# EasyEDA Pro project 天猛星1.eprj

# Schematic Schematic1
Board Name: Board1; Create Date: 2025-07-03; Page Name: P1; Project Name: 天猛星; Schematic Name: Schematic1; Update Date: 2025-07-04; Company: 嘉立创EDA; Page Size: A4; Version: V1.0
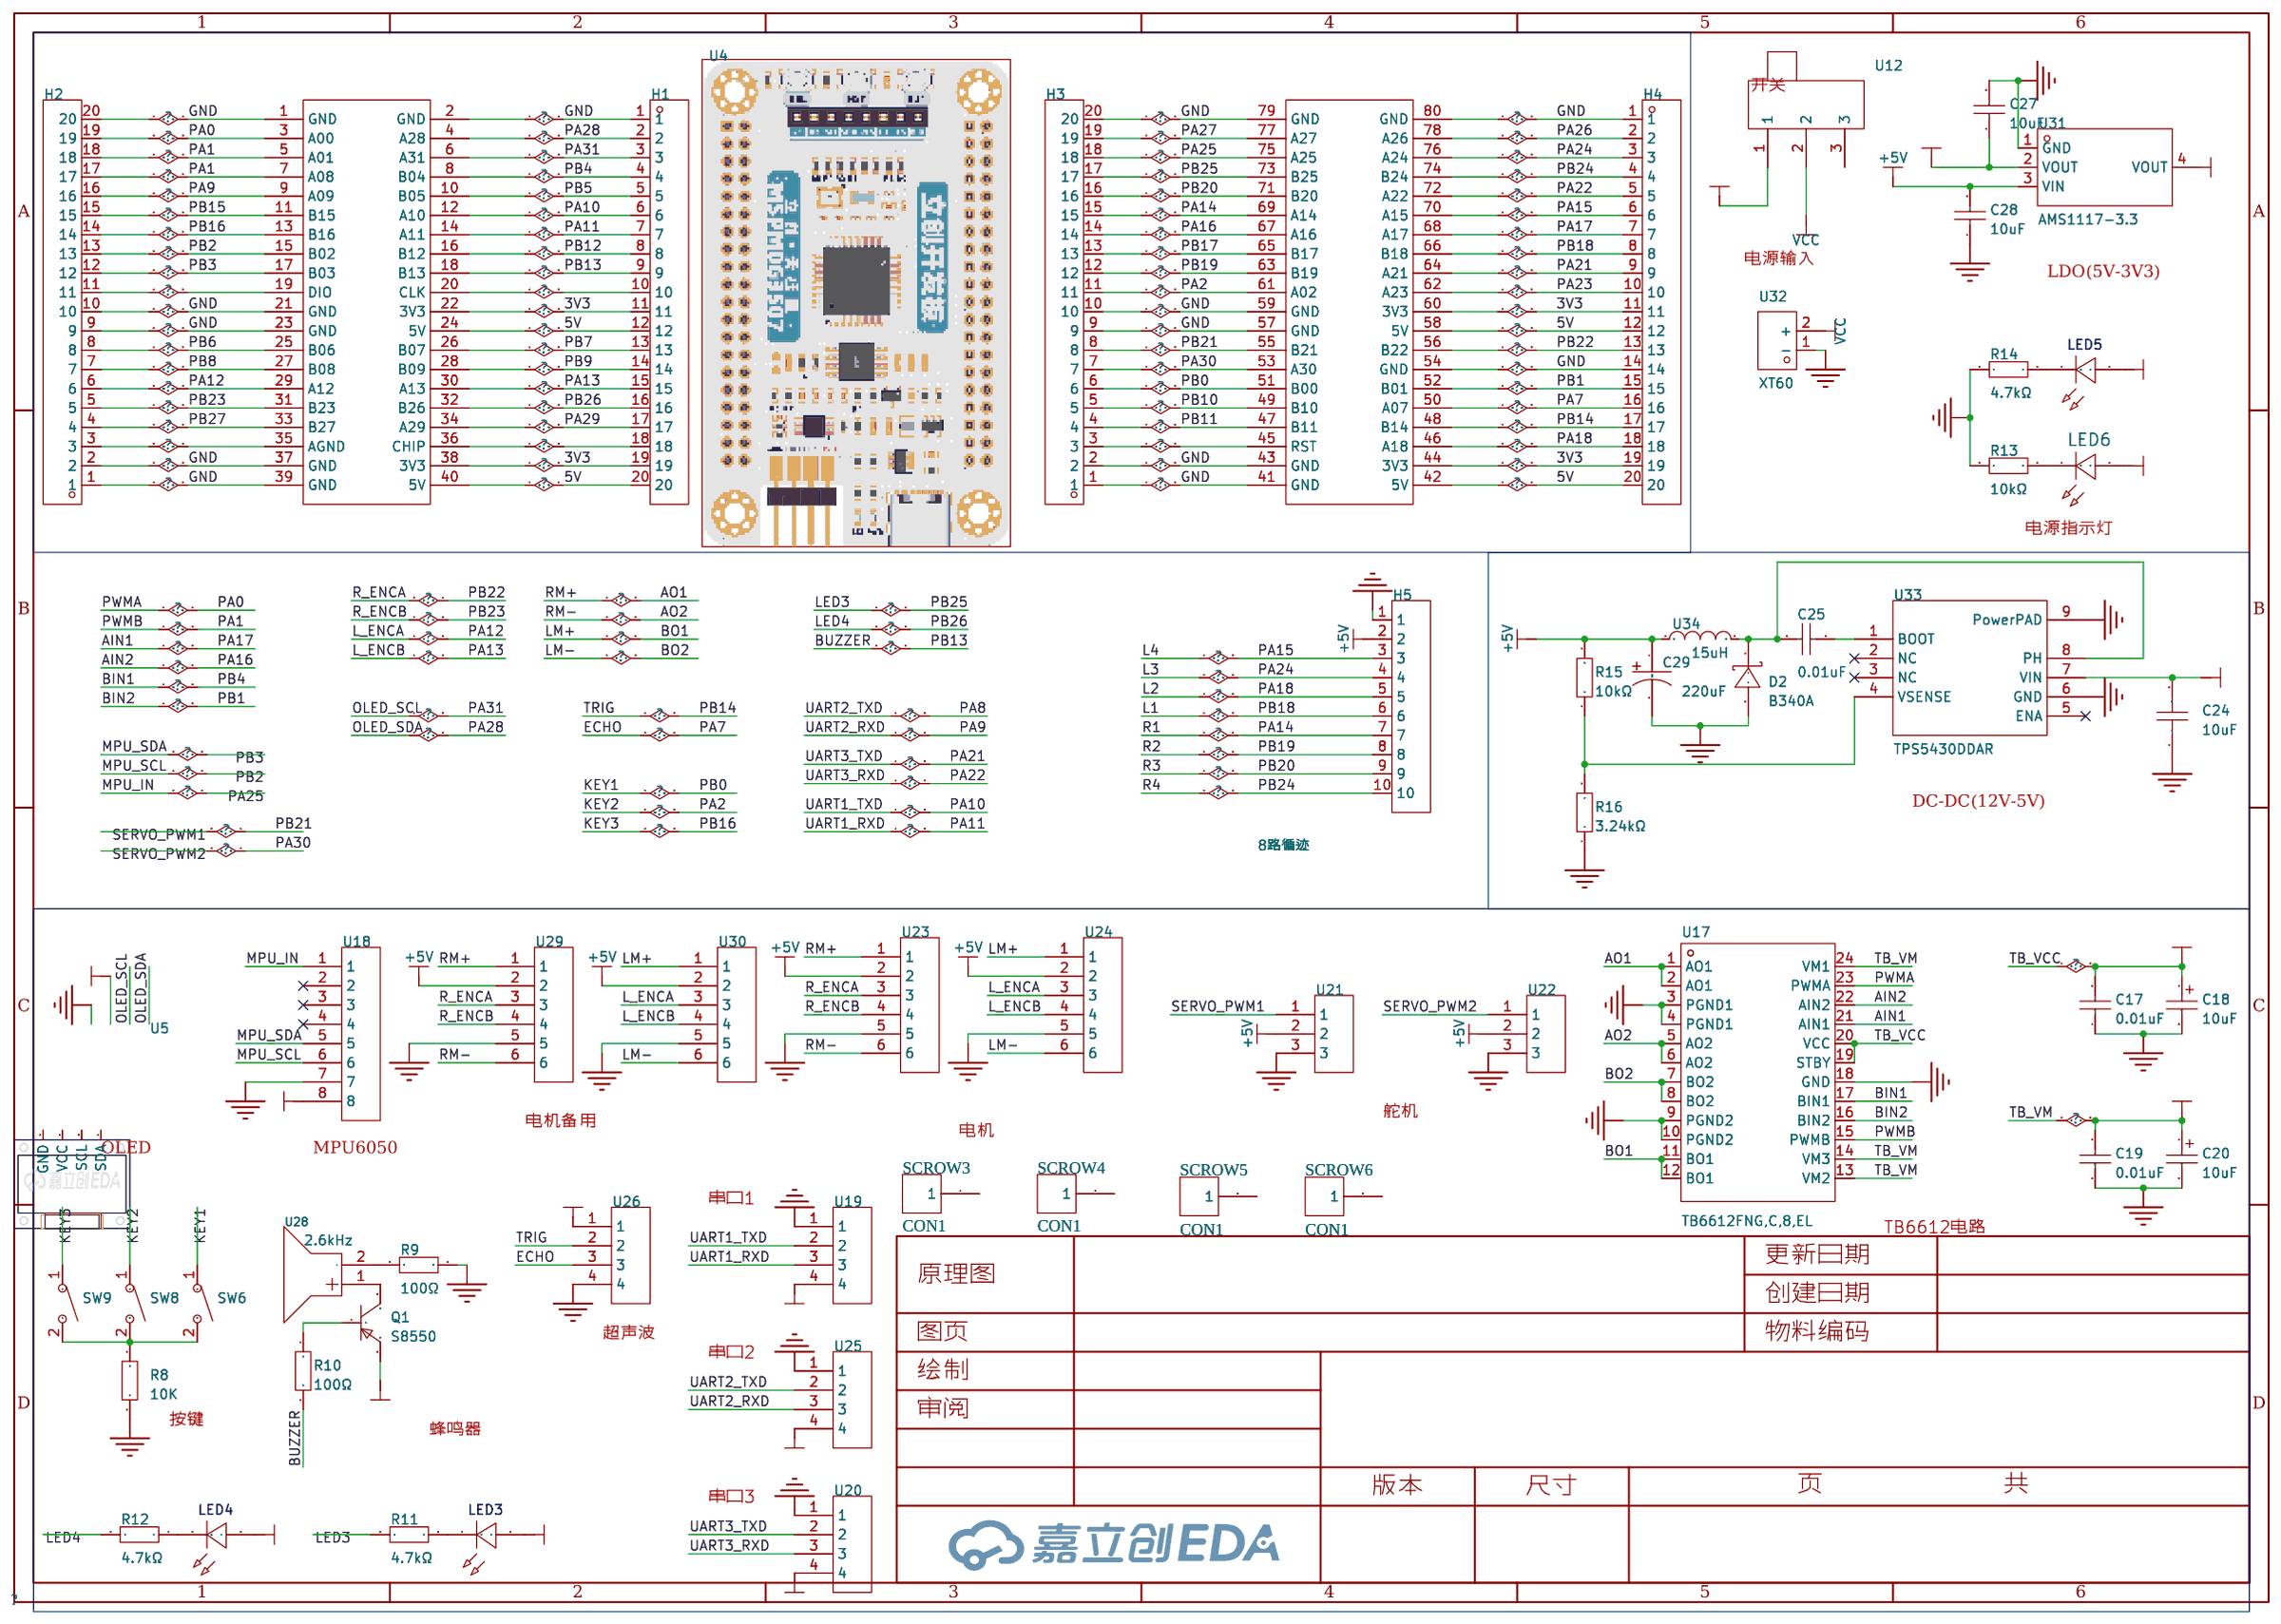
[diagram p0: schematic sheet]

## Parts
C17  0.01uF  [C0603]
C18  10uF  [case-b_3528]
C19  0.01uF  [C0603]
C20  10uF  [case-b_3528]
C24  10uF  [C0603]
C25  0.01uF  [C0603]
C27  10uF  [C0603]
C28  10uF  [C0603]
C29  220uF  [CAP-SMD_BD6.3-L6.6-W6.6-LS7.2-R-RD]
D2  B340A  [SMA_L4.3-W2.6-LS5.1-RD]
H1  -  [HDR-TH_20P-P2.54-V-M-1]
H2  -  [HDR-TH_20P-P2.54-V-M-1]
H3  -  [HDR-TH_20P-P2.54-V-M-1]
H4  -  [HDR-TH_20P-P2.54-V-M-1]
H5  8路循迹  [HDR-TH_10P-P2.54-V-M]
LED3  -  [led0603_blue]
LED4  -  [led0603_blue]
LED5  -  [led_0603]
LED6  -  [led_0603]
Q1  S8550  [SOT-23-3_L2.9-W1.6-P1.90-LS2.8-BR]
R8  10K  [R0603]
R9  100Ω  [R0603]
R10  100Ω  [R0603]
R11  4.7kΩ  [R0603]
R12  4.7kΩ  [R0603]
R13  10kΩ  [R0603]
R14  4.7kΩ  [R0603]
R15  10kΩ  [R0603]
R16  3.24kΩ  [R0603]
SCROW3  CON1  [LQ_SCROW3&5MM]
SCROW4  CON1  [LQ_SCROW3&5MM]
SCROW5  CON1  [LQ_SCROW3&5MM]
SCROW6  CON1  [LQ_SCROW3&5MM]
SW6  轻触按键3*6*2.5  [SW-SMD_L6.0-W3.6-LS8.0]
SW8  轻触按键3*6*2.5  [SW-SMD_L6.0-W3.6-LS8.0]
SW9  轻触按键3*6*2.5  [SW-SMD_L6.0-W3.6-LS8.0]
U4  LCKFB-TMX-MSPM0G3507  [COMM-TH_LCKFB-TMX-MSPM0G3507]
U5  -  [0.96OLED_4P]
U12  -  [拨动开关]
U17  TB6612FNG,C,8,EL  [SSOP-24_L8.3-W5.6-P0.65-LS7.6-BL]
U18  -  [MPU6050-8p]
U19  -  [XH2.54_4p]
U20  -  [XH2.54_4p]
U21  -  [X2.54_3p]
U22  -  [X2.54_3p]
U23  -  [XH2.54_6p]
U24  -  [XH2.54_6p]
U25  -  [XH2.54_4p]
U26  -  [XH2.54_4p]
U28  2.6kHz  [BUZ-TH_BD12.0-P7.60-D0.6-FD]
U29  -  [ph2.0]
U30  -  [ph2.0]
U31  AMS1117-3.3  [SOT-223-3_L6.5-W3.4-P2.30-LS7.0-BR]
U32  XT60  [CONN-TH_XT60]
U33  TPS5430DDAR  [ESOP-8_L4.9-W3.9-P1.27-LS6.0-TL-EP]
U34  15uH  [IND-SMD_L6.6-W6.6]

## Library data of the parts
C17 C19 C25 C27 C28 = CL10C100JB8NNNC: 容值:10pF;精度:±5%;额定电压:50V;材质(温度系数):C0G;; LCSC Part Name: 10pF ±5% 50V; Supplier Part: C1634; Manufacturer: SAMSUNG(三星); Supplier Footprint: 0603; JLCPCB Part Class: 基础库; Datasheet: https://atta.szlcsc.com/upload/public/pdf/source/20160218/1457707763339.pdf; Supplier: LCSC; Tolerance: ±5%; Voltage Rated: 50V; Temperature Coefficient: C0G
C18 C20 = TAJC227K010RNJ: 容值:220uF;精度:±10%;额定电压:10V;等效串联电阻:500mΩ@100kHz;; LCSC Part Name: 220uF ±10% 10V; Supplier Part: C8023; Manufacturer: Kyocera AVX; Supplier Footprint: CASE-C-6032; JLCPCB Part Class: 扩展库; Datasheet: https://atta.szlcsc.com/upload/public/pdf/source/20160107/1457707750344.pdf; Supplier: LCSC; Tolerance: ±10%; Rated Voltage: 10V; Equivalent Series Resistance(ESR): 500mΩ@100kHz; Operating Temperature: -55℃~+125℃
C24 = CL10A106KP8NNNC: 容值:10uF;精度:±10%;额定电压:10V;材质(温度系数):X5R;; LCSC Part Name: 10uF ±10% 10V; Supplier Part: C19702; Manufacturer: SAMSUNG(三星); Supplier Footprint: 0603; JLCPCB Part Class: 基础库; Datasheet: https://atta.szlcsc.com/upload/public/pdf/source/20160218/1457707763339.pdf; Supplier: LCSC; Tolerance: ±10%; Voltage Rated: 10V; Temperature Coefficient: X5R
C29 = VZT221M1CTR-0606ACS: 容值:220uF;精度:±20%;额定电压:16V;电容体直径:6.3mm;电容体长度:5.8mm;纹波电流:-;等效串联电阻:-;工作寿命:2000hrs@105℃;工作温度:-45℃~+105℃;; LCSC Part Name: 220uF ±20% 16V; Supplier Part: C286136; Manufacturer: lelon(立隆); Supplier Footprint: SMD,D6.3xL5.8mm; JLCPCB Part Class: Extended Part; Datasheet: https://atta.szlcsc.com/upload/public/pdf/source/20180921/C286136_B135157883311A80483BB6A4D6974578.pdf; Supplier: LCSC; Tolerance: ±20%; Rated Voltage: 16V; φD: 6.3mm; L: 5.8mm; Lifetime @ Temp: 2000hrs@105℃; Operating Temperature: -45℃~+105℃
D2 = B340A: 正向压降(Vf):550mV@3A;直流反向耐压(Vr):40V;平均整流电流(Io):3A;; LCSC Part Name: 电压:40V 电流:3A; Supplier Part: C64982; Manufacturer: MDD; Supplier Footprint: SMA(DO-214AC); JLCPCB Part Class: 扩展库; Datasheet: https://atta.szlcsc.com/upload/public/pdf/source/20230710/CC7CF81239BC87A7012E02A96905E83C.pdf; Supplier: LCSC; Forward Voltage (Vf@If): 550mV@3A; Reverse Voltage (Vr): 40V; Average Rectified Current (Io): 3A
H1-H4 = HDR-M_2.54_1x20P: 间距:2.54mm;总PIN位数:20;排数:1;插针结构:-;行距:-;安装类型:直插;圆针/方针:-;额定电流:-;额定电压:-;配合针长度:-;塑高:-;触头材质:黄铜;触头镀层:-;颜色:黑色;; Supplier Part: C50981; Supplier Footprint: 插件
H5 = PZ254V-11-10P: 插针结构:1x10P;间距:2.54mm;行距:-;圆针/方针:方针;安装方式:直插;排数:单排;总PIN位数:10P;额定电流:-;额定电压:-;配合针长度:6mm;塑高:2.5mm;端接针长度:3mm;触头材质:黄铜;触头镀层:-;工作温度:-40℃~+105℃;颜色:黑色;; LCSC Part Name: 1x10P 间距:2.54mm 方针 直插; Supplier Part: C492409; Manufacturer: XFCN(兴飞); Supplier Footprint: 插件,P=2.54mm; JLCPCB Part Class: 扩展库; Datasheet: https://atta.szlcsc.com/upload/public/pdf/source/20200309/C492409_129C9431BDD62EBBBD0A643B6AAB9FBD.pdf; Supplier: LCSC; Pin Structure: 1x10P; Pitch: 2.54mm; Circluar Pins/Square Pins: 方针; Mounting Type: 直插; Number of Rows: 单排; Number of Pins: 10P; Length of Mating Pin: 6mm; Insulation Height: 2.5mm; Length of End Connection Pin: 3mm; Contact Material: 黄铜; Operating Temperature: -40℃~+105℃; Color: 黑色
LED3-LED5 = LED_0402-G: Supplier Footprint: 0402
LED6 = LED_0402-R: Supplier Footprint: 0402
Q1 = S8550_C105432: 晶体管类型:PNP;集电极电流(Ic):500mA;集射极击穿电压(Vceo):25V;功率(Pd):300mW;直流电流增益(hFE@Ic,Vce):120@50mA,1V;; LCSC Part Name: S8550(RANGE:120-200) L档120-200; Supplier Part: C105432; Manufacturer: CJ(江苏长电/长晶); Supplier Footprint: SOT-23; JLCPCB Part Class: 基础库; Datasheet: https://atta.szlcsc.com/upload/public/pdf/source/20171228/C164891_15144412930301213894.pdf; Supplier: LCSC; Transistor Type: PNP; Collector Current (Ic): 500mA; Collector-Emitter Breakdown Voltage (Vceo): 25V; Power Dissipation (Pd): 300mW; DC Current Gain (hFE@Ic,Vce): 120@50mA,1V; Transition Frequency (fT): 150MHz; Collector Cut-Off Current (Icbo): 100nA; Collector-Emitter Saturation Voltage (VCE(sat)@Ic,Ib): 600mV@500mA,50mA
R8-R10 = Res_0603: Supplier Footprint: 0603
R11-R14 = 0603WAF4701T5E: 电阻类型:厚膜电阻;阻值:4.7kΩ;精度:±1%;功率:100mW;最大工作电压:75V;温度系数:±100ppm/℃;; LCSC Part Name: 4.7kΩ ±1% 100mW 厚膜电阻; Supplier Part: C23162; Manufacturer: UNI-ROYAL(厚声); Supplier Footprint: 0603; JLCPCB Part Class: 基础库; Datasheet: https://atta.szlcsc.com/upload/public/pdf/source/20200306/C422600_1E6D84923E4A46A82E41ADD87F860B5C.pdf; Supplier: LCSC; Type: 厚膜电阻; Tolerance: ±1%; Power(Watts): 100mW; Overload Voltage (Max): 75V; Temperature Coefficient: ±100ppm/℃; Operating Temperature Range: -55℃~+155℃
R15 R16 = 0603WAF1002T5E: 电阻类型:厚膜电阻;阻值:10kΩ;精度:±1%;功率:100mW;最大工作电压:75V;温度系数:±100ppm/℃;; LCSC Part Name: 厚膜电阻 10kΩ ±1% 100mW; Supplier Part: C25804; Manufacturer: UNI-ROYAL(厚声); Supplier Footprint: 0603; JLCPCB Part Class: 基础库; Datasheet: https://atta.szlcsc.com/upload/public/pdf/source/20200306/C422600_1E6D84923E4A46A82E41ADD87F860B5C.pdf; Supplier: LCSC; Type: 厚膜电阻; Tolerance: ±1%; Power(Watts): 100mW; Overload Voltage (Max): 75V; Temperature Coefficient: ±100ppm/℃; Operating Temperature Range: -55℃~+155℃
SCROW3-SCROW6 = CON1: Connector; Library Name: LQ8701
SW6 SW8 SW9 = 轻触按键3*6*2.5: Supplier Part: C9900013040; Supplier Footprint: KEY; JLCPCB Part Class: 扩展库; Supplier: LCSC
U4 = LCKFB-TMX-MSPM0G3507: LCSC Part Name: 立创·天猛星MSPM0G3507开发板 5件套; Supplier Part: C42378531; Manufacturer: 立创开发板; Datasheet: https://atta.szlcsc.com/upload/public/pdf/source/20241209/800332349277522348D9357AB5109808.pdf; Supplier: LCSC
U5 = 0.96OLED模块_4P: Supplier Footprint: 插件
U12 = 拨动开关
U17 = TB6612FNG,C,8,EL: 驱动电机类型:有刷直流电机;电源电压:2.7V~5.5V;输出电流:1A;接口:并行;; LCSC Part Name: 1A 有刷直流电机驱动芯片 5.5V; Supplier Part: C141517; Manufacturer: TOSHIBA(东芝); Supplier Footprint: SSOP-24; JLCPCB Part Class: 扩展库; Datasheet: https://atta.szlcsc.com/upload/public/pdf/source/20171128/C141517_15118625624231147036.pdf; Supplier: LCSC; Drive motor type: 有刷直流电机; Supply Voltage: 2.7V~5.5V; Output Current: 1A; Interface: 并行; Operating Temperature: -20℃~+85℃@(Ta)
U18 = MPU6050_8p
U19 U20 U25 U26 = XH2.54_4P
U21 U22 = X2.54 _3p
U23 U24 U29 U30 = XH2.54_6p
U28 = HYE1206-05ST: 频率:2.6kHz;声压(SPL):80dB@5V,10cm;; LCSC Part Name: 有源蜂鸣器HYE1206-05ST; Supplier Part: C17701079; Manufacturer: HYDZ(华宇); Supplier Footprint: 插件,D=7.6mm; Datasheet: https://atta.szlcsc.com/upload/public/pdf/source/20230912/EF3443D3A1B92F495A3EE65EE7F2091F.pdf; Supplier: LCSC; Sound Pressure Level (SPL): 80dB@5V,10cm
U31 = AMS1117-3.3_C6186: 输出类型:固定;最大输入电压:-;输出电压:3.3V;最大输出电流:1A;电源纹波抑制比(PSRR):72dB@(120Hz);输出极性:正极;; LCSC Part Name: 输出3.3V 1A; Supplier Part: C6186; Manufacturer: AMS; Supplier Footprint: SOT-223; JLCPCB Part Class: 基础库; Datasheet: https://atta.szlcsc.com/upload/public/pdf/source/20180727/C6186_7A095716F0823C02F1997A905E26C086.pdf; Supplier: LCSC; Output Type: 固定; Output Voltage: 3.3V; MAX Output Current: 1A; Power Supply Rejection Ratio (PSRR): 72dB@(120Hz); Dropout Voltage: 1.3V@(800mA); Output Polarity: 正极; Number of Outputs: 1
U32 = XT60: 类别:-;类型1:-;; LCSC Part Name: AMASS(艾迈斯) XT60模型插头 3.5mm镀金香蕉头公头（电调端）XT60-M; Supplier Part: C98733; Manufacturer: AMASS(艾迈斯); JLCPCB Part Class: 扩展库; Datasheet: https://atta.szlcsc.com/upload/public/pdf/source/20170606/1496716524919.pdf; Supplier: LCSC; Brand: 艾迈斯; Type: 香蕉头; Colour: 黄色; InterfaceType: 公头; specifications: 3.5mm
U33 = TPS5430DDAR: 功能类型:降压型;输出类型:可调;输入电压:5.5V~36V;输出电压:1.221V~32.04V;输出电流(最大值):3A;; LCSC Part Name: 降压 3A 36V; Supplier Part: C9864; Manufacturer: TI(德州仪器); Supplier Footprint: SOIC-8-EP; JLCPCB Part Class: 基础库; Datasheet: https://www.ti.com/cn/lit/gpn/tps5430; Supplier: LCSC; Function: 降压型; Output Type: 可调; Input Voltage: 5.5V~36V; Output Voltage: 1.221V~32.04V; Output Current (Max): 3A; Switching Frequency: 500kHz; Operating Temperature: -40℃~+125℃@(TJ); Synchronous Rectification: 否; Number of Outputs: 1; Topology: 降压式; Switch tube (built-in/external): 内置
U34 = 15uH: Supplier Part: C9900014578; Supplier Footprint: L_电感_7*7; JLCPCB Part Class: 扩展库; Supplier: LCSC

## Nets
3V3: C17.2 C18.1 C27.1 H1.11 H1.19 H4.11 H4.19 LED3.2(A) LED4.2(A) LED5.2(A) Q1.2 U4.22(3V3) U4.38(3V3) U4.44(3V3) U4.60(3V3) U17.19(STBY) U17.20(VCC) U18.8 U19.4 U20.4 U25.4 U26.1 U31.2(VOUT) U31.4(VOUT)
5V: H1.12 H1.20 H4.12 H4.20 U4.24(5V) U4.40(5V) U4.42(5V) U4.58(5V)
+5V: C28.2 C29.1 H5.2 LED6.2(A) R15.2 U21.2 U22.2 U23.2 U24.2 U29.2 U30.2 U31.3(VIN) U34.1
+12V: C19.2 C20.1 C24.2 U12.1 U17.13(VM2) U17.14(VM3) U17.24(VM1) U33.7(VIN)
GND: C17.1 C18.2 C19.1 C20.2 C24.1 C27.2 C28.1 C29.2 D2.2(A) H1.1 H2.1 H2.2 H2.9 H2.10 H2.20 H3.1 H3.2 H3.9 H3.10 H3.20 H4.1 H4.14 H5.1 R8.2 R9.1 R13.2 R14.2 R16.1 U4.1(GND) U4.2(GND) U4.21(GND) U4.23(GND) U4.37(GND) U4.39(GND) U4.41(GND) U4.43(GND) U4.54(GND) U4.57(GND) U4.59(GND) U4.79(GND) U4.80(GND) U17.3(PGND1) U17.4(PGND1) U17.9(PGND2) U17.10(PGND2) U17.18(GND) U18.7 U19.1 U20.1 U21.3 U22.3 U23.5 U24.5 U25.1 U26.4 U29.5 U30.5 U31.1(GND) U32.1(-) U33.6(GND) U33.9(PowerPAD)
VCC: U12.2 U32.2(+)
AIN1: H4.7 U4.68(A17) U17.21(AIN1)
AIN2: H3.14 U4.67(A16) U17.22(AIN2)
AO1: U17.1(AO1) U17.2(AO1) U23.1 U29.1
AO2: U17.5(AO2) U17.6(AO2) U23.6 U29.6
BIN1: H1.4 U4.8(B04) U17.17(BIN1)
BIN2: H4.15 U4.52(B01) U17.16(BIN2)
BO1: U17.11(BO1) U17.12(BO1) U24.1 U30.1
BO2: U17.7(BO2) U17.8(BO2) U24.6 U30.6
BUZZER: H1.9 R10.2 U4.18(B13)
ECHO: H4.16 U4.50(A07) U26.3
KEY1: H3.6 SW6.1 U4.51(B00)
KEY2: H3.11 SW8.1 U4.61(A02)
KEY3: H2.14 SW9.1 U4.13(B16)
L1: H4.8 H5.6 U4.66(B18)
L2: H4.18 H5.5 U4.46(A18)
L3: H4.3 H5.4 U4.76(A24)
L4: H4.6 H5.3 U4.70(A15)
L_ENCA: H2.6 U4.29(A12) U24.3 U30.3
L_ENCB: H1.15 U4.30(A13) U24.4 U30.4
LED3: H3.17 R11.2 U4.73(B25)
LED4: H1.16 R12.2 U4.32(B26)
MPU_IN: H3.18 U4.75(A25) U18.1
MPU_SCL: H2.13 U4.15(B02) U18.6
MPU_SDA: H2.12 U4.17(B03) U18.5
OLED_SCL: H1.3 U4.6(A31)
OLED_SDA: H1.2 U4.4(A28)
PA0: H2.19 U4.3(A00) U17.23(PWMA)
PA1: H2.17 H2.18 U4.5(A01) U4.7(A08) U17.15(PWMB)
PA8: U25.2
PA9: H2.16 U4.9(A09) U25.3
PA10: H1.6 U4.12(A10) U19.2
PA11: H1.7 U4.14(A11) U19.3
PA14: H3.15 H5.7 U4.69(A14)
PA21: H4.9 U4.64(A21) U20.2
PA22: H4.5 U4.72(A22) U20.3
PA23: H4.10 U4.62(A23)
PA26: H4.2 U4.78(A26)
PA27: H3.19 U4.77(A27)
PA29: H1.17 U4.34(A29)
PA30: H3.7 U4.53(A30) U22.1
PB5: H1.5 U4.10(B05)
PB6: H2.8 U4.25(B06)
PB7: H1.13 U4.26(B07)
PB8: H2.7 U4.27(B08)
PB9: H1.14 U4.28(B09)
PB10: H3.5 U4.49(B10)
PB11: H3.4 U4.47(B11)
PB12: H1.8 U4.16(B12)
PB14: H4.17 U4.48(B14) U26.2
PB15: H2.15 U4.11(B15)
PB17: H3.13 U4.65(B17)
PB19: H3.12 H5.8 U4.63(B19)
PB20: H3.16 H5.9 U4.71(B20)
PB21: H3.8 U4.55(B21) U21.1
PB22: H4.13 U4.56(B22) U23.3 U29.3
PB23: H2.5 U4.31(B23) U23.4 U29.4
PB24: H4.4 H5.10 U4.74(B24)
PB27: H2.4 U4.33(B27)
$1N3235: H2.11 U4.19(DIO)
$1N3243: H2.3 U4.35(AGND)
$1N3271: H1.18 U4.36(CHIP)
$1N3274: H1.10 U4.20(CLK)
$1N3374: H3.3 U4.45(RST)
$1N5970: R8.1 SW6.2 SW8.2 SW9.2
$1N5979: LED3.1(C) R11.1
$1N5981: LED4.1(C) R12.1
$1N5986: Q1.3 U28.1(+)
$1N5988: Q1.1 R10.1
$1N5990: R9.2 U28.2(-)
$1N7998: LED5.1(C) R14.1
$1N8000: LED6.1(C) R13.1
$1N8507: C25.2 U33.1(BOOT)
$1N8508: C25.1 D2.1(K) U33.8(PH) U34.2
$1N8510: R15.1 R16.2 U33.4(VSENSE)

Not connected (* = marked no-connect by the designer): SCROW3 1; SCROW4 1; SCROW5 1; SCROW6 1; U5 1(GND) 2(VCC) 3(SCL) 4(SDA); U12 3; U18 2* 3* 4*; U33 2(NC)* 3(NC)* 5(ENA)*

## Notes on the sheet
- 开关
- 电源输入
- LDO(5V-3V3)
- 电源指示灯
- DC-DC(12V-5V)
- 电机备用
- 舵机
- OLED
- MPU6050
- 电机
- 串口1
- TB6612电路
- 超声波
- 串口2
- 按键
- 蜂鸣器
- 串口3

# Board PCB1
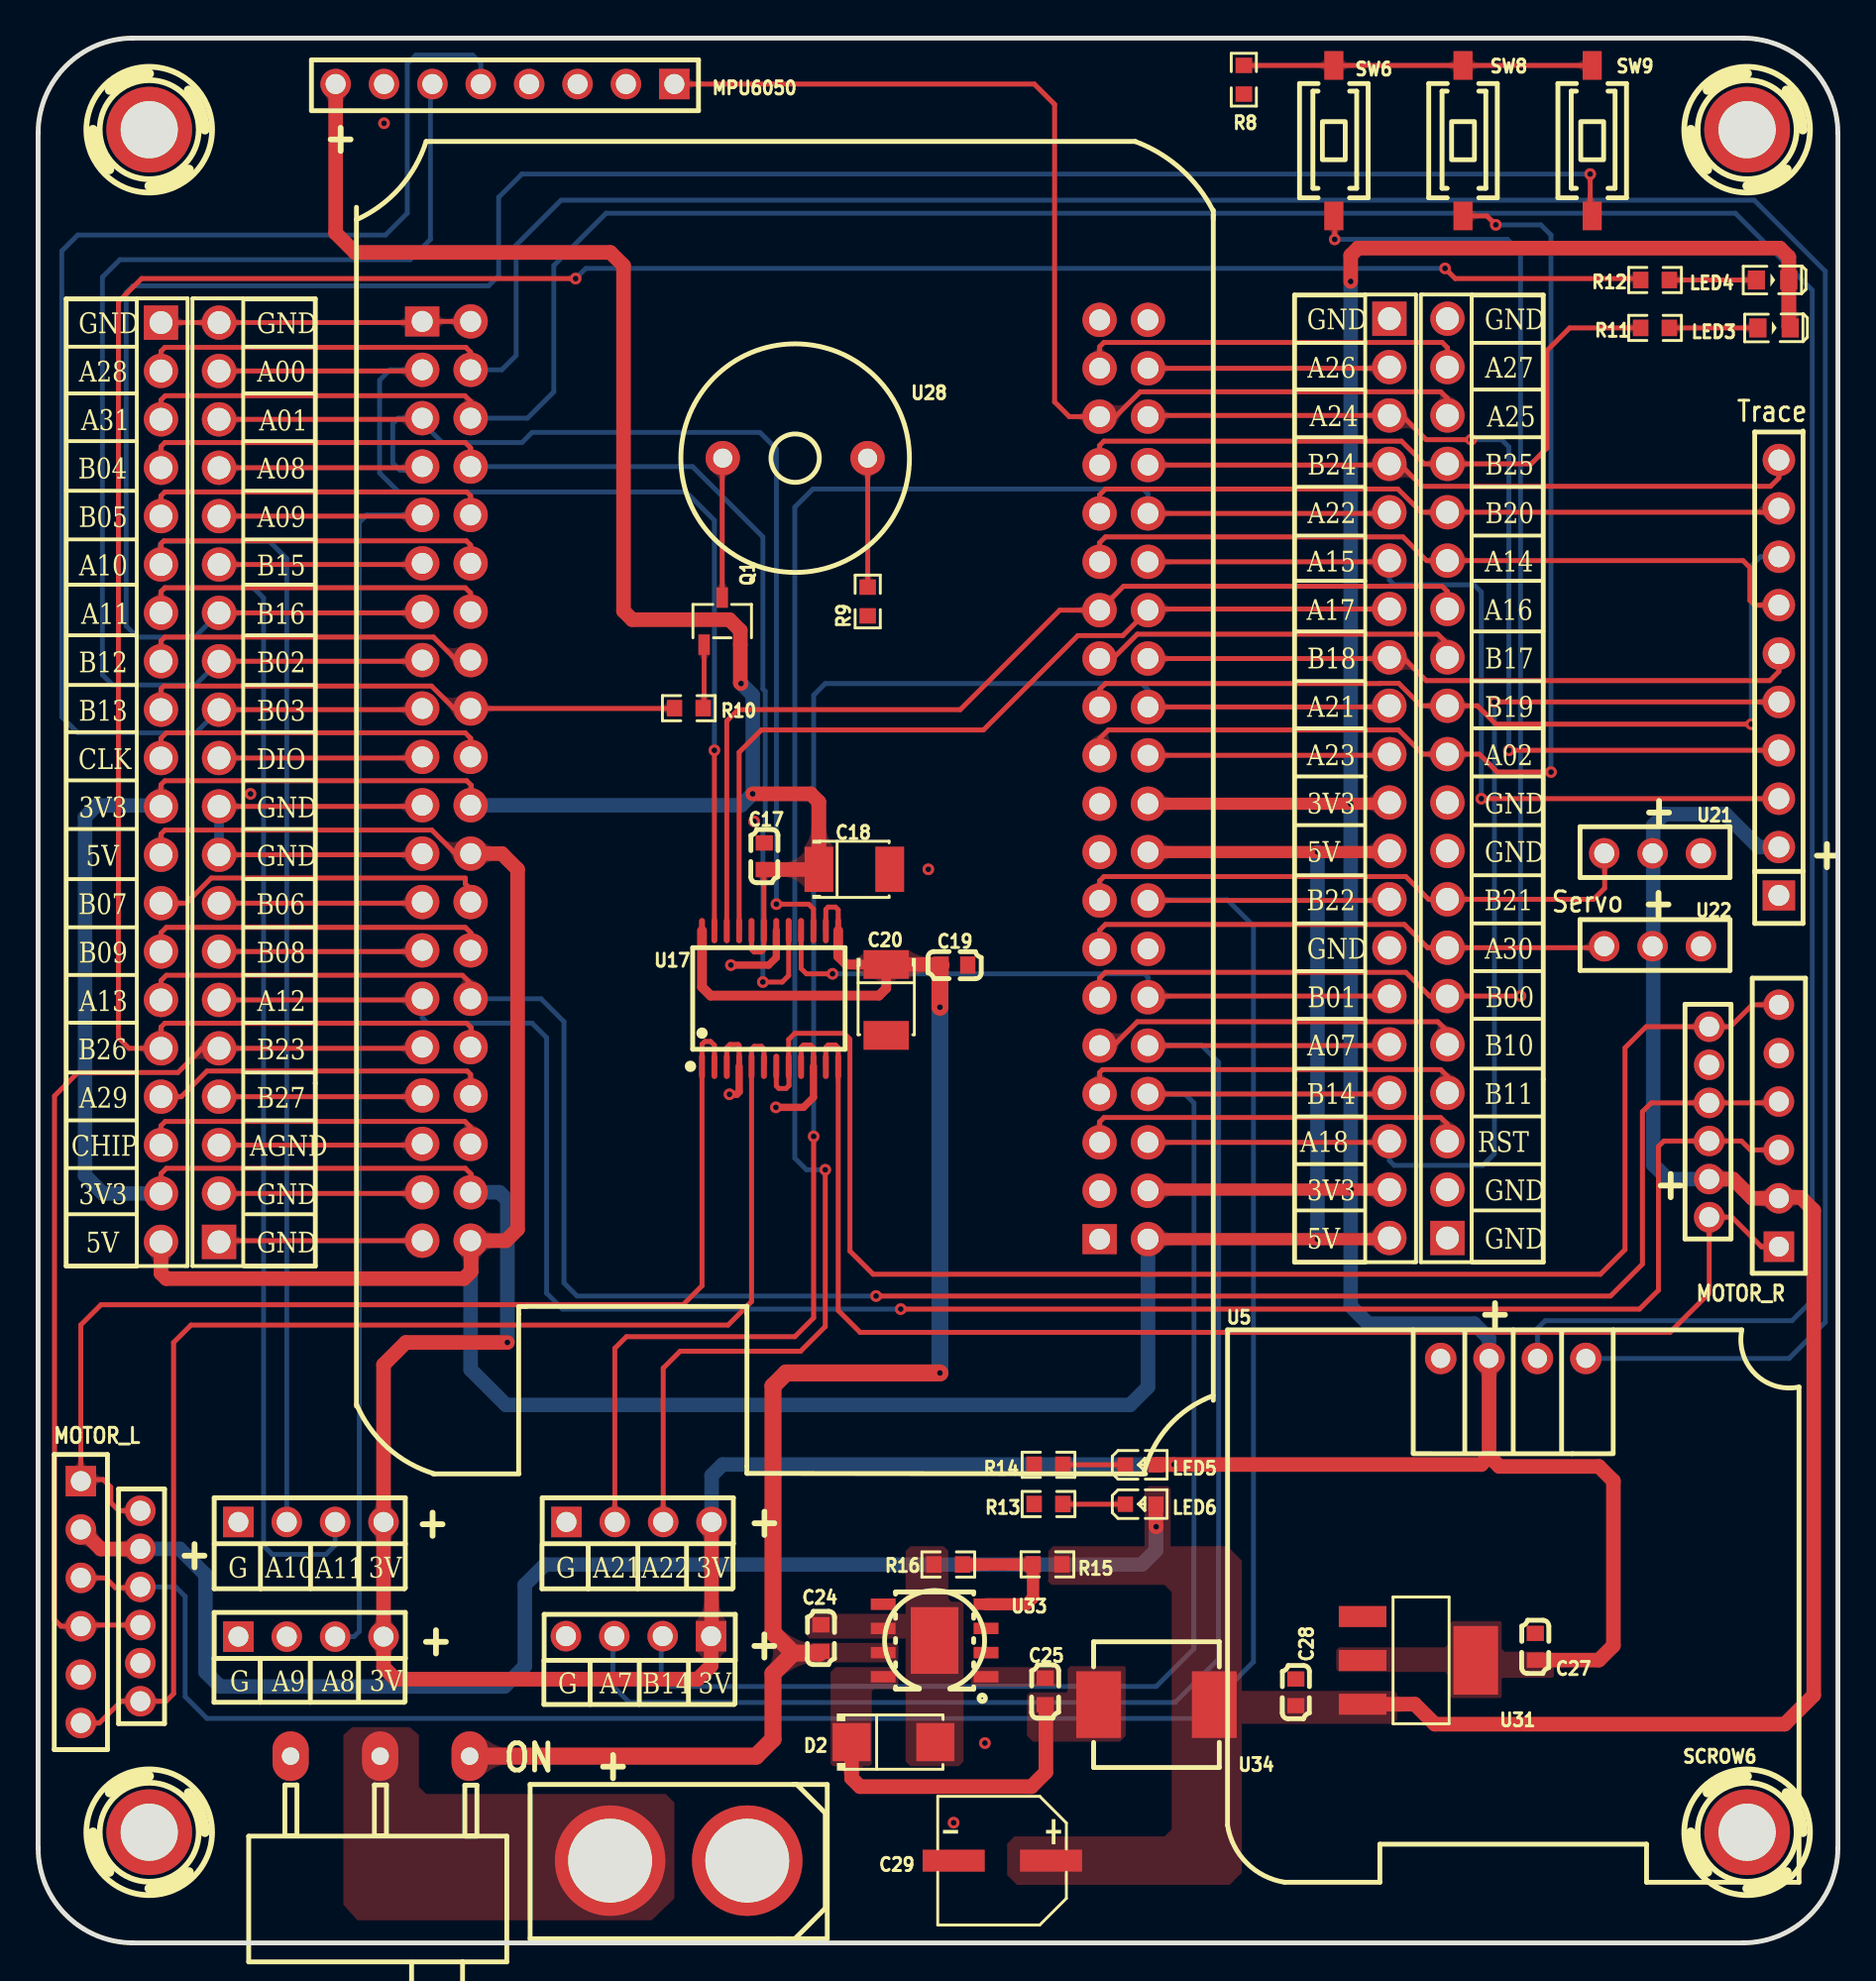
[diagram p1: board, top side]